# EasyEDA Pro project ProPrj_Avaota A1 八核 AIoT 开发板_2024-05-03.epro, schematic Avaota Pi A, sheets 1 to 5 of 13

## Sheets
1 POWER
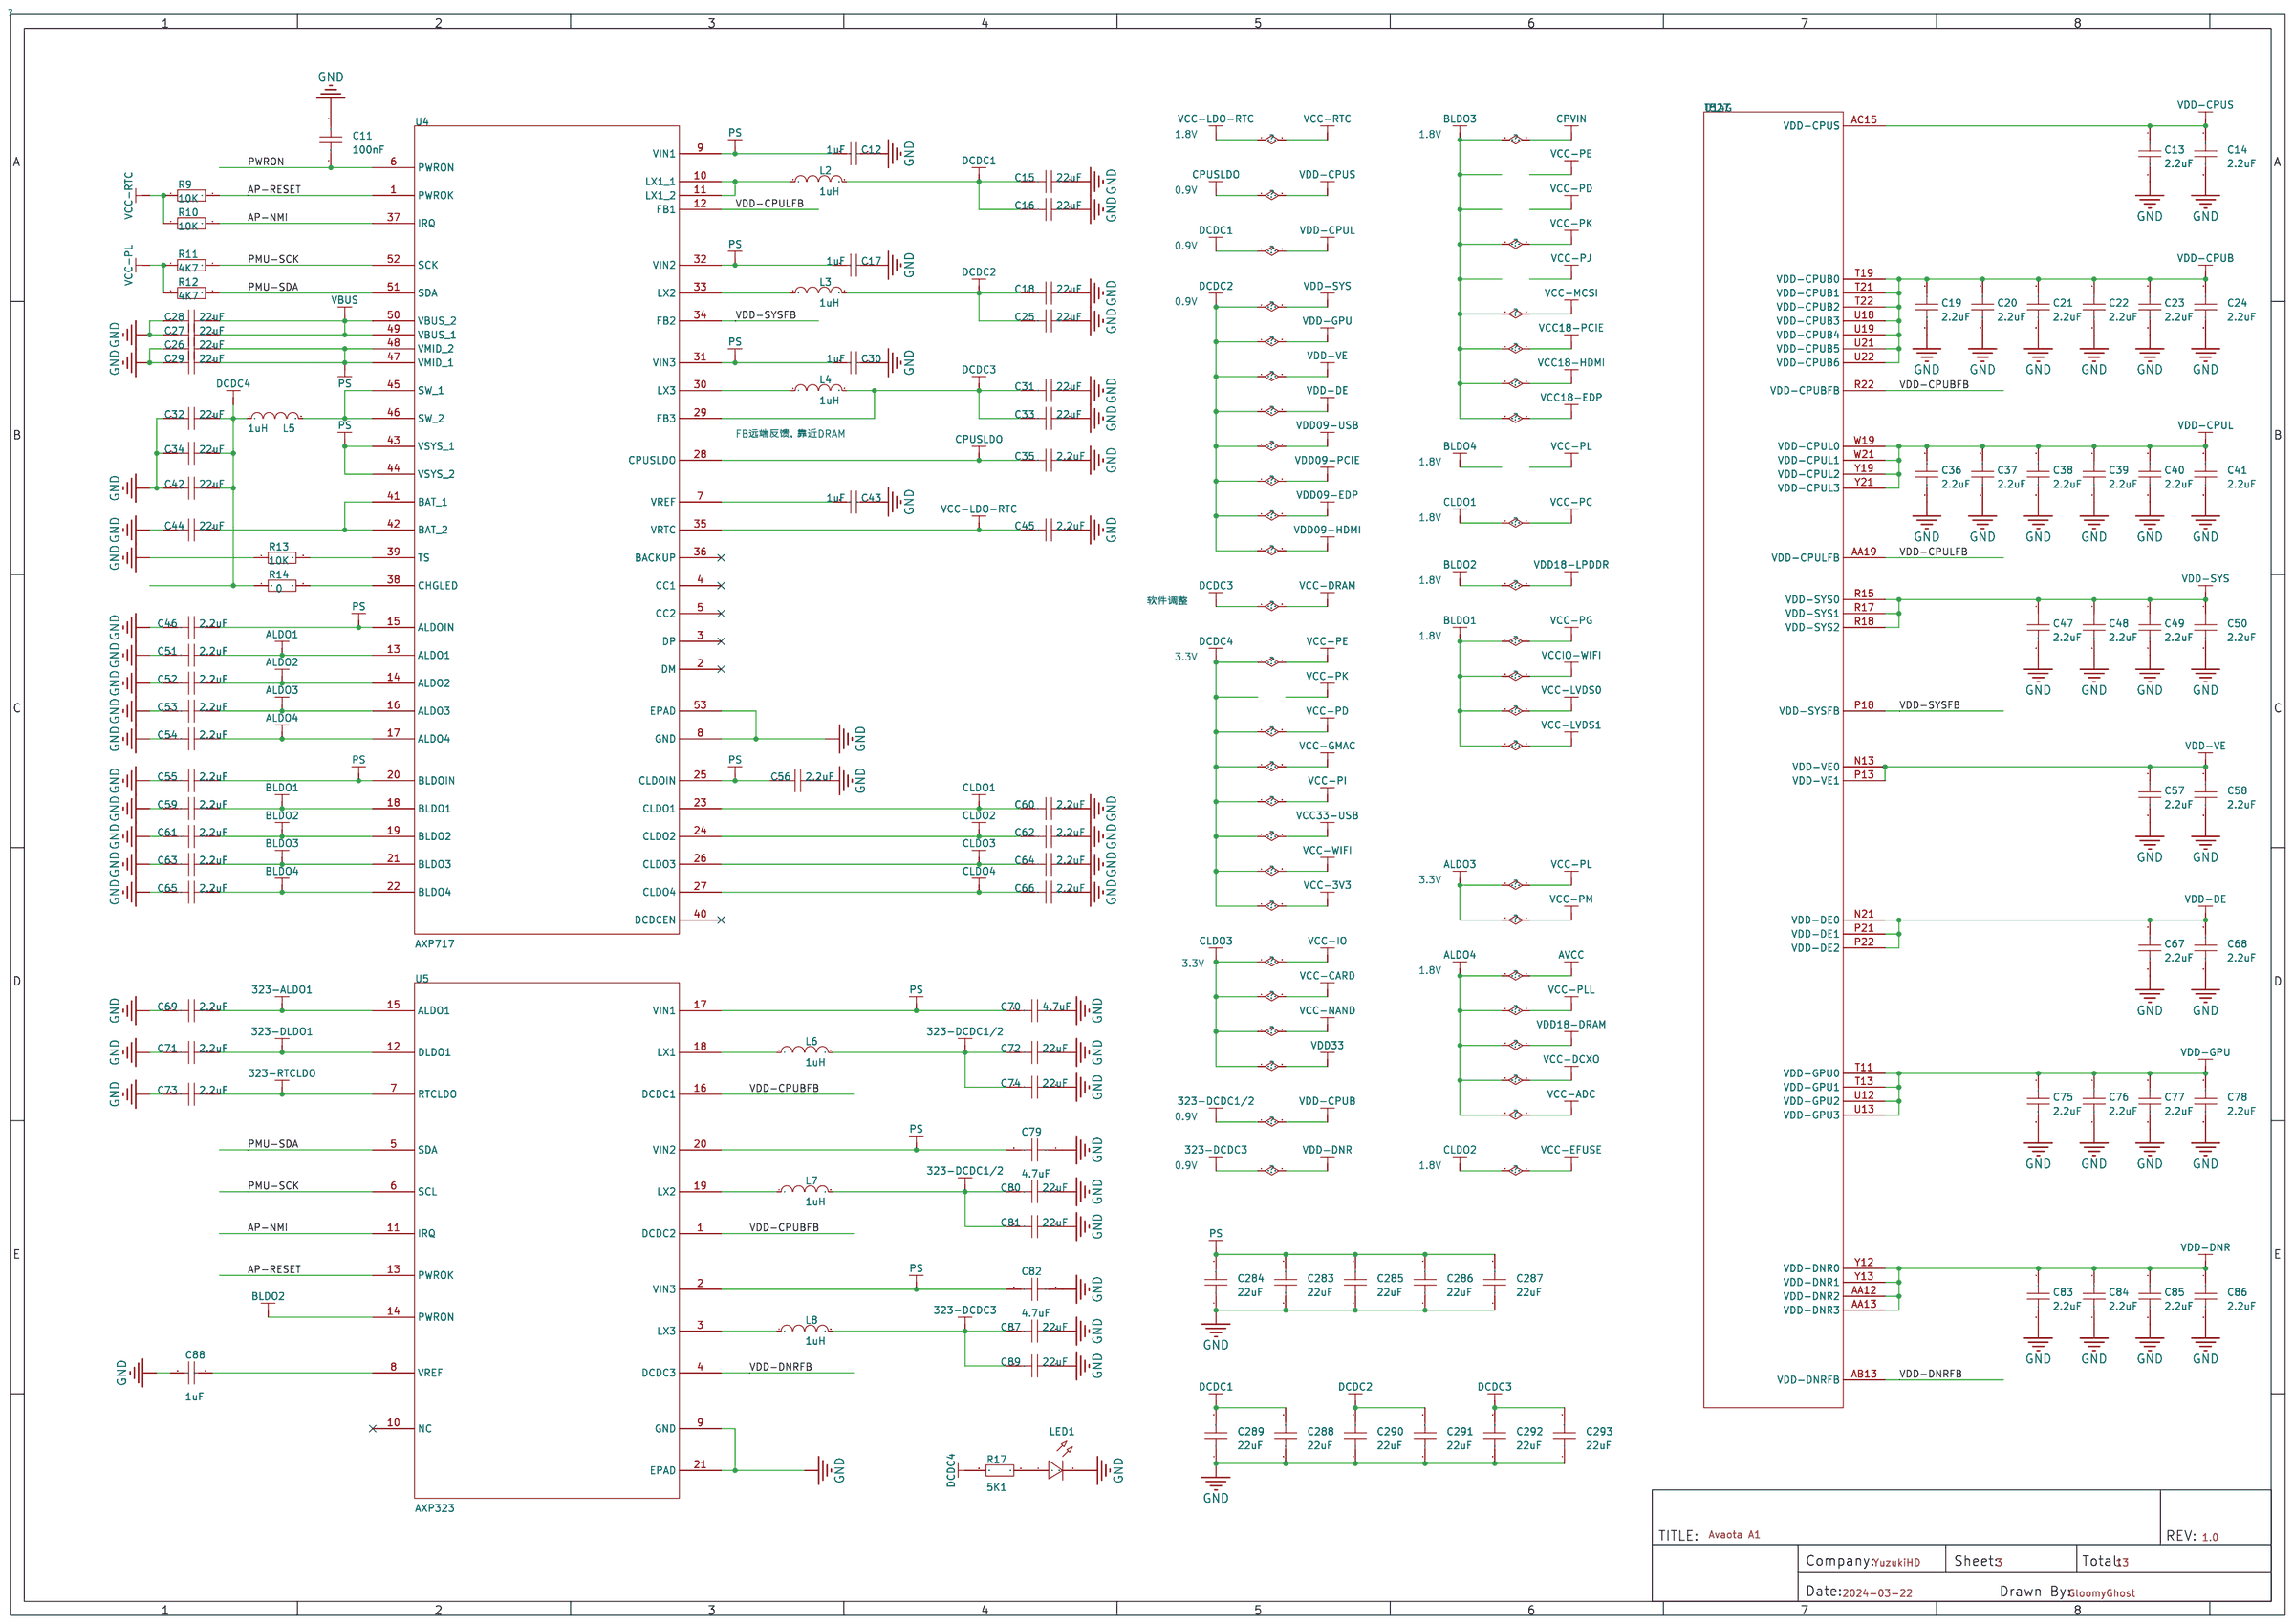
[diagram p0: POWER]
2 SYSTEM
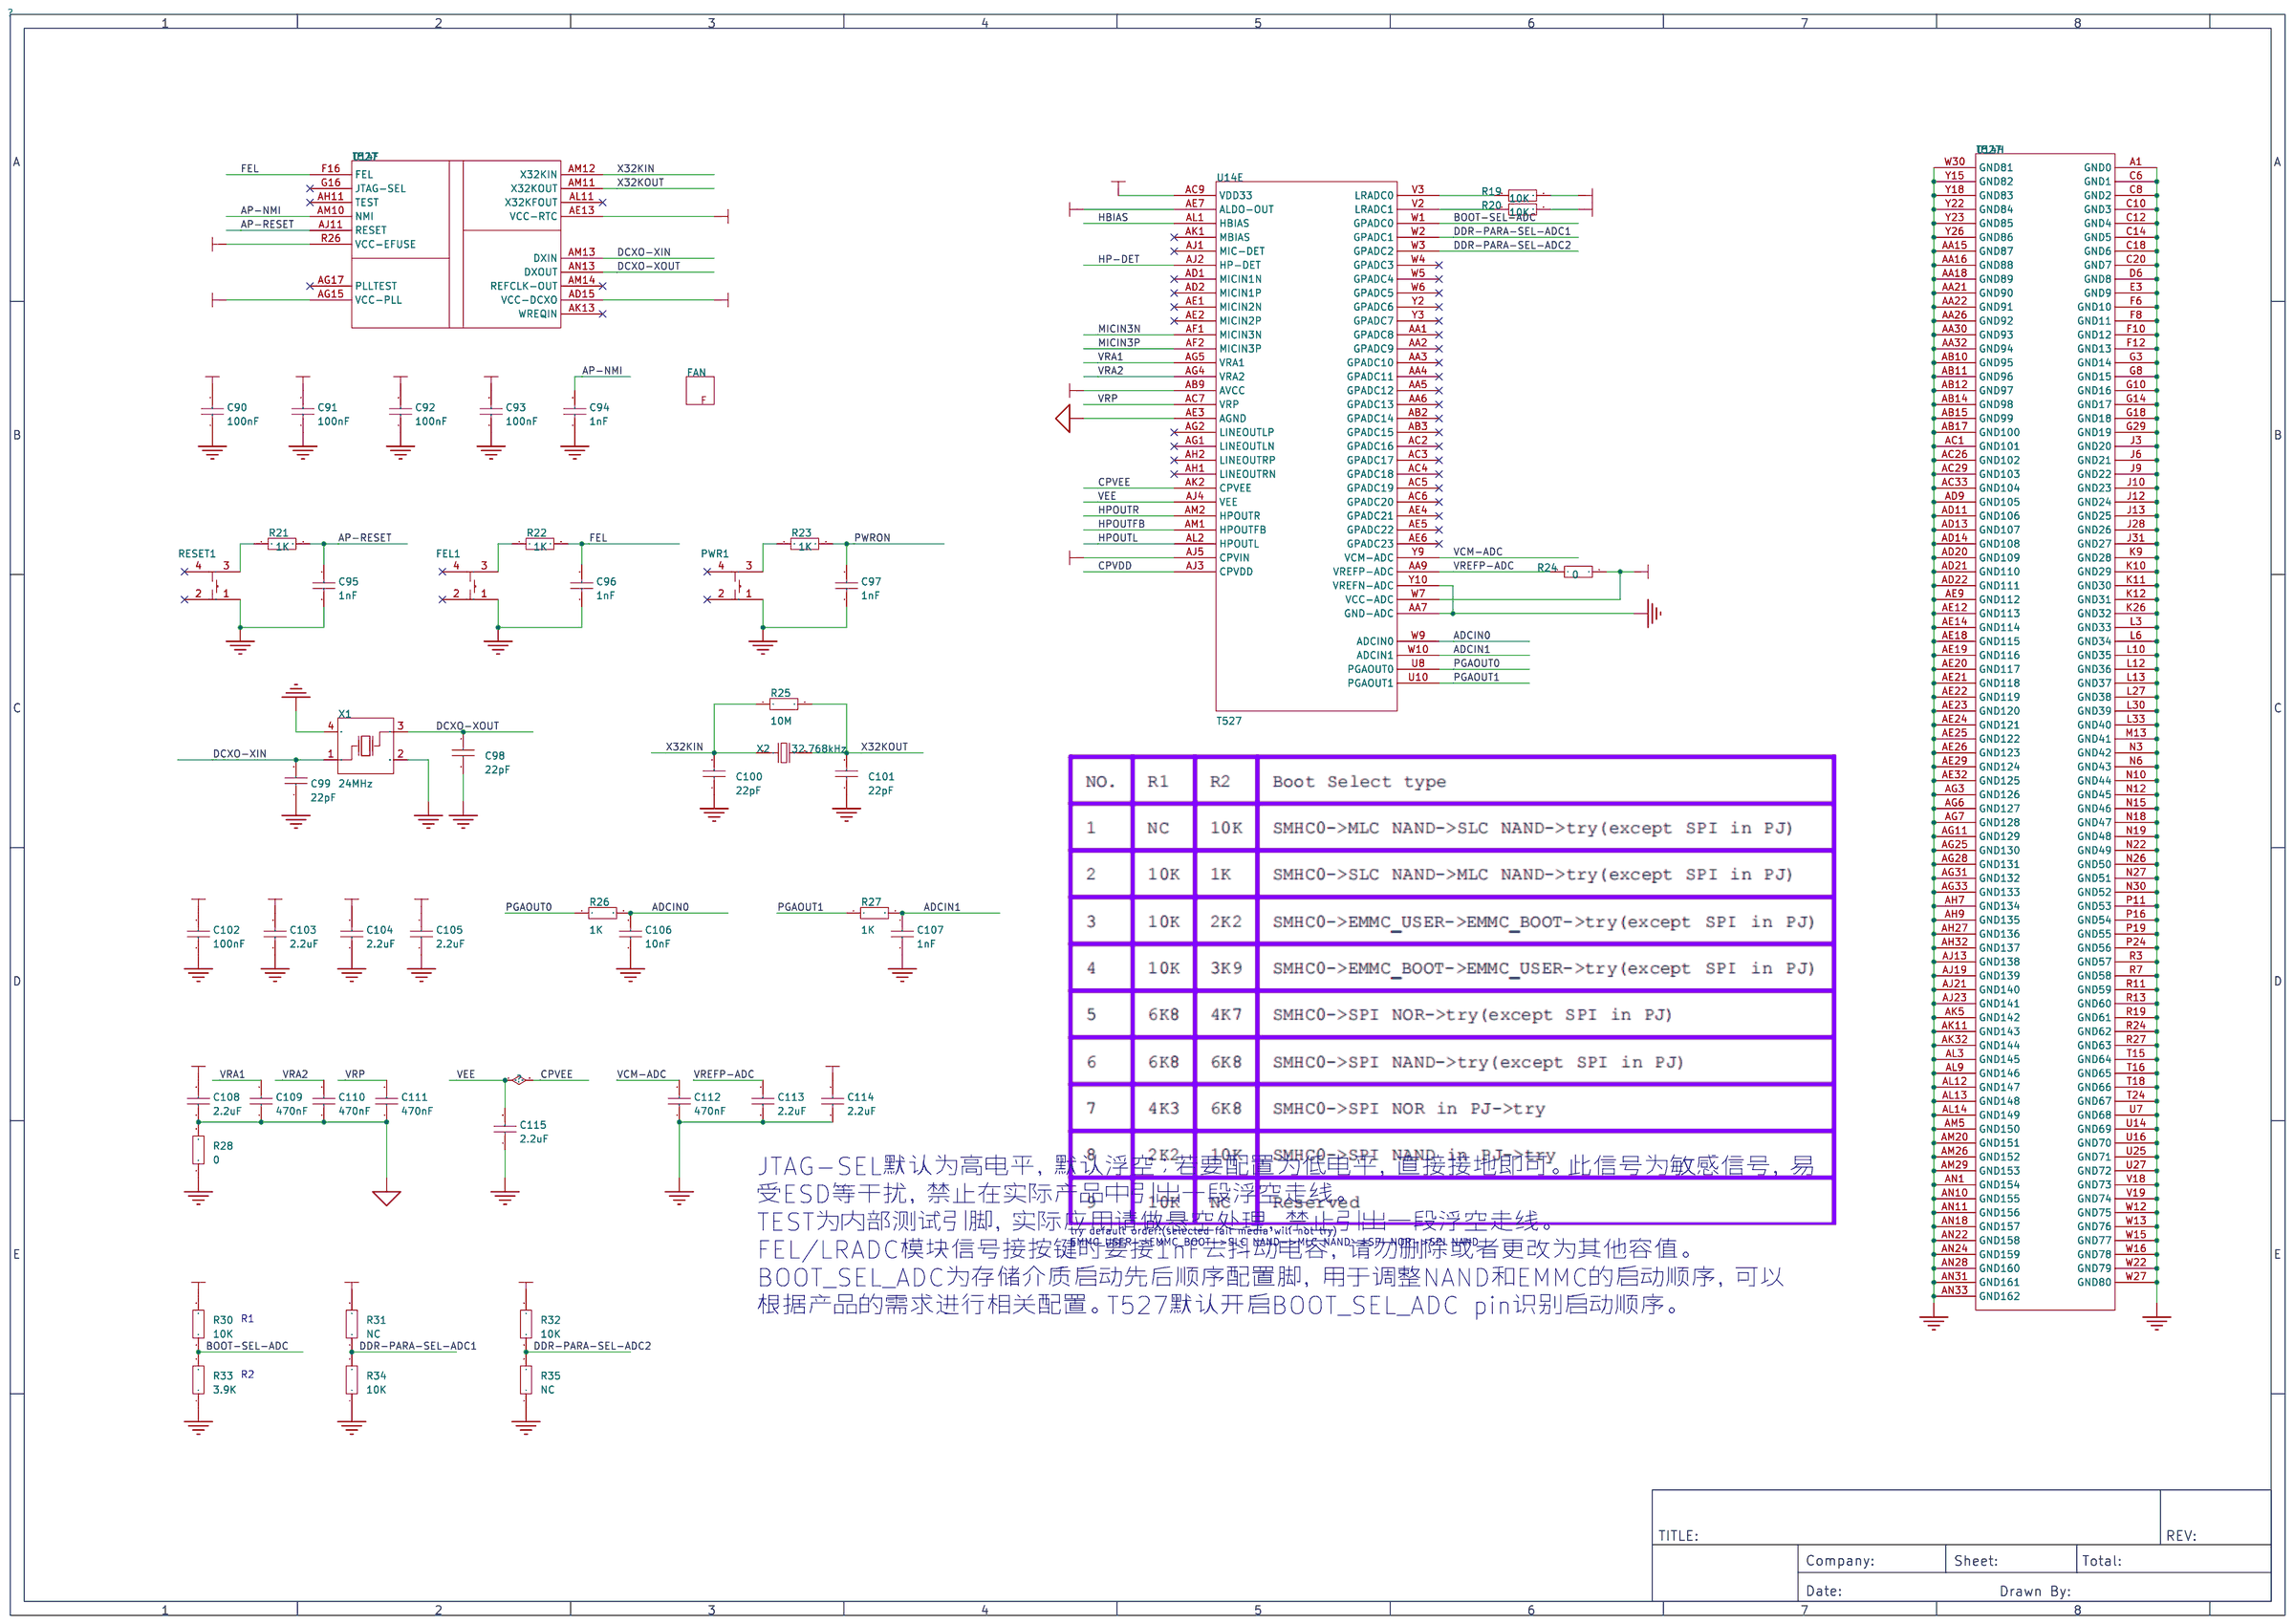
[diagram p1: SYSTEM]
3 DRAM
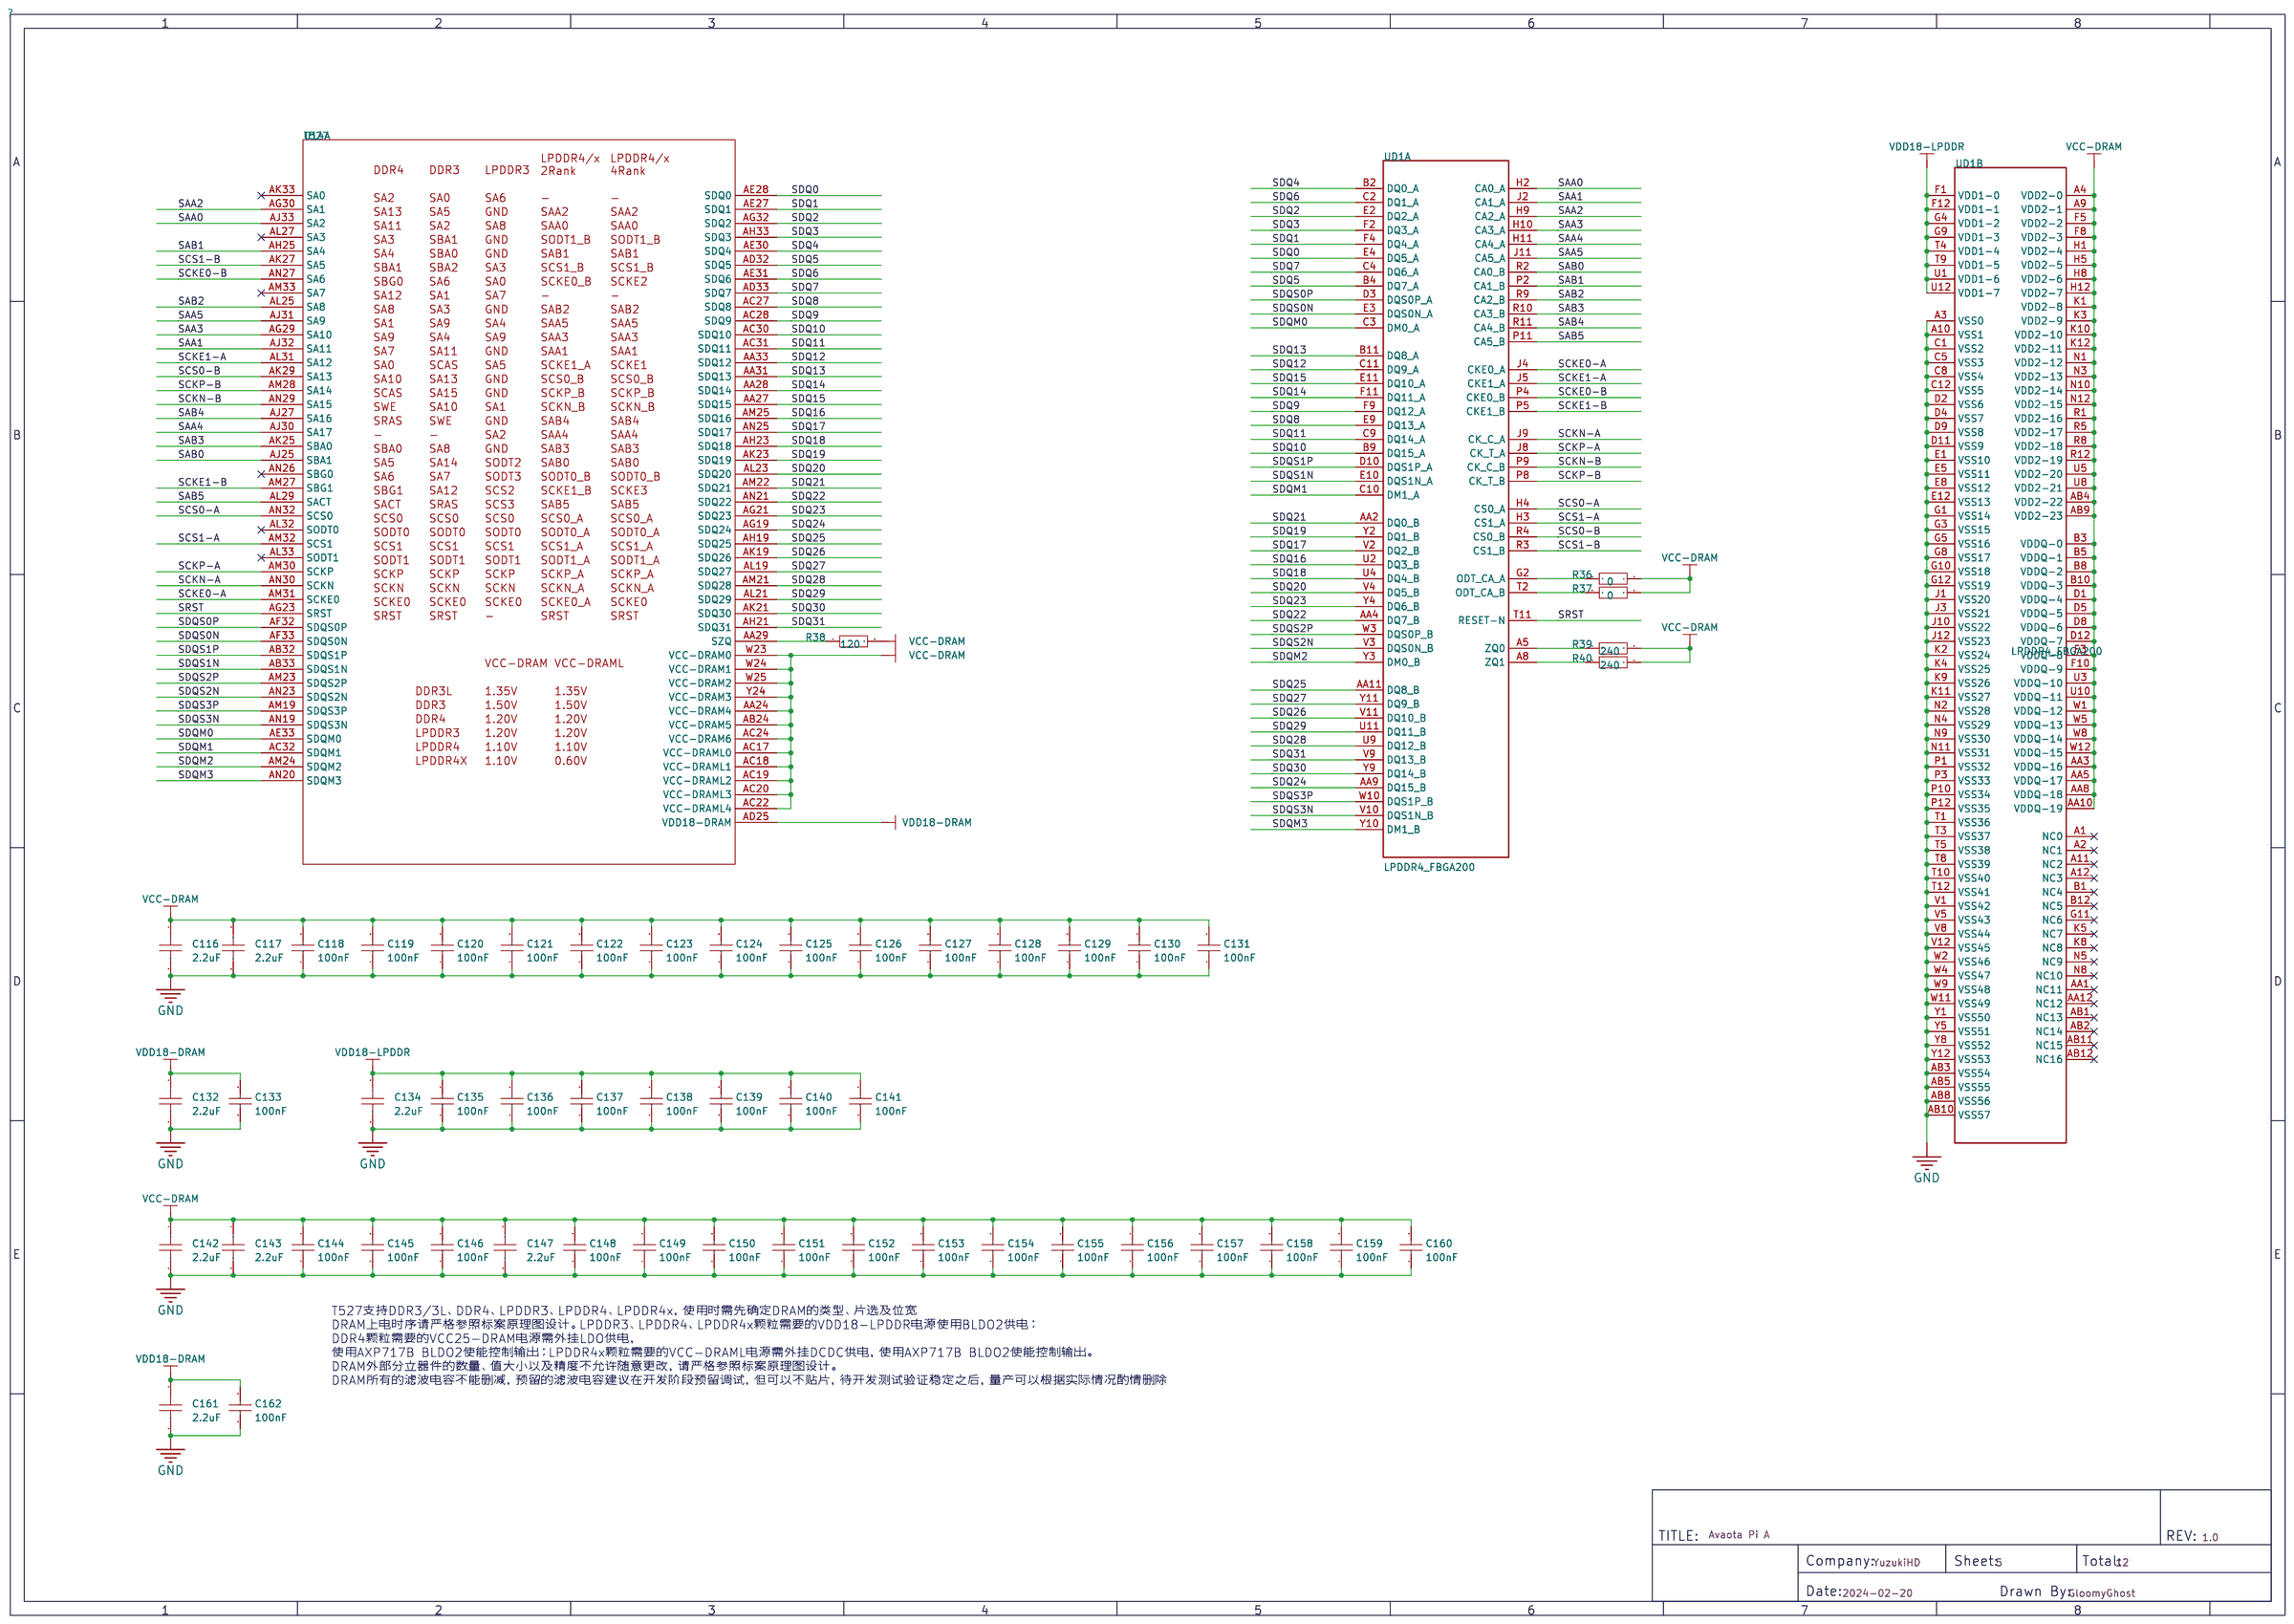
[diagram p2: DRAM]
4 GPIO1
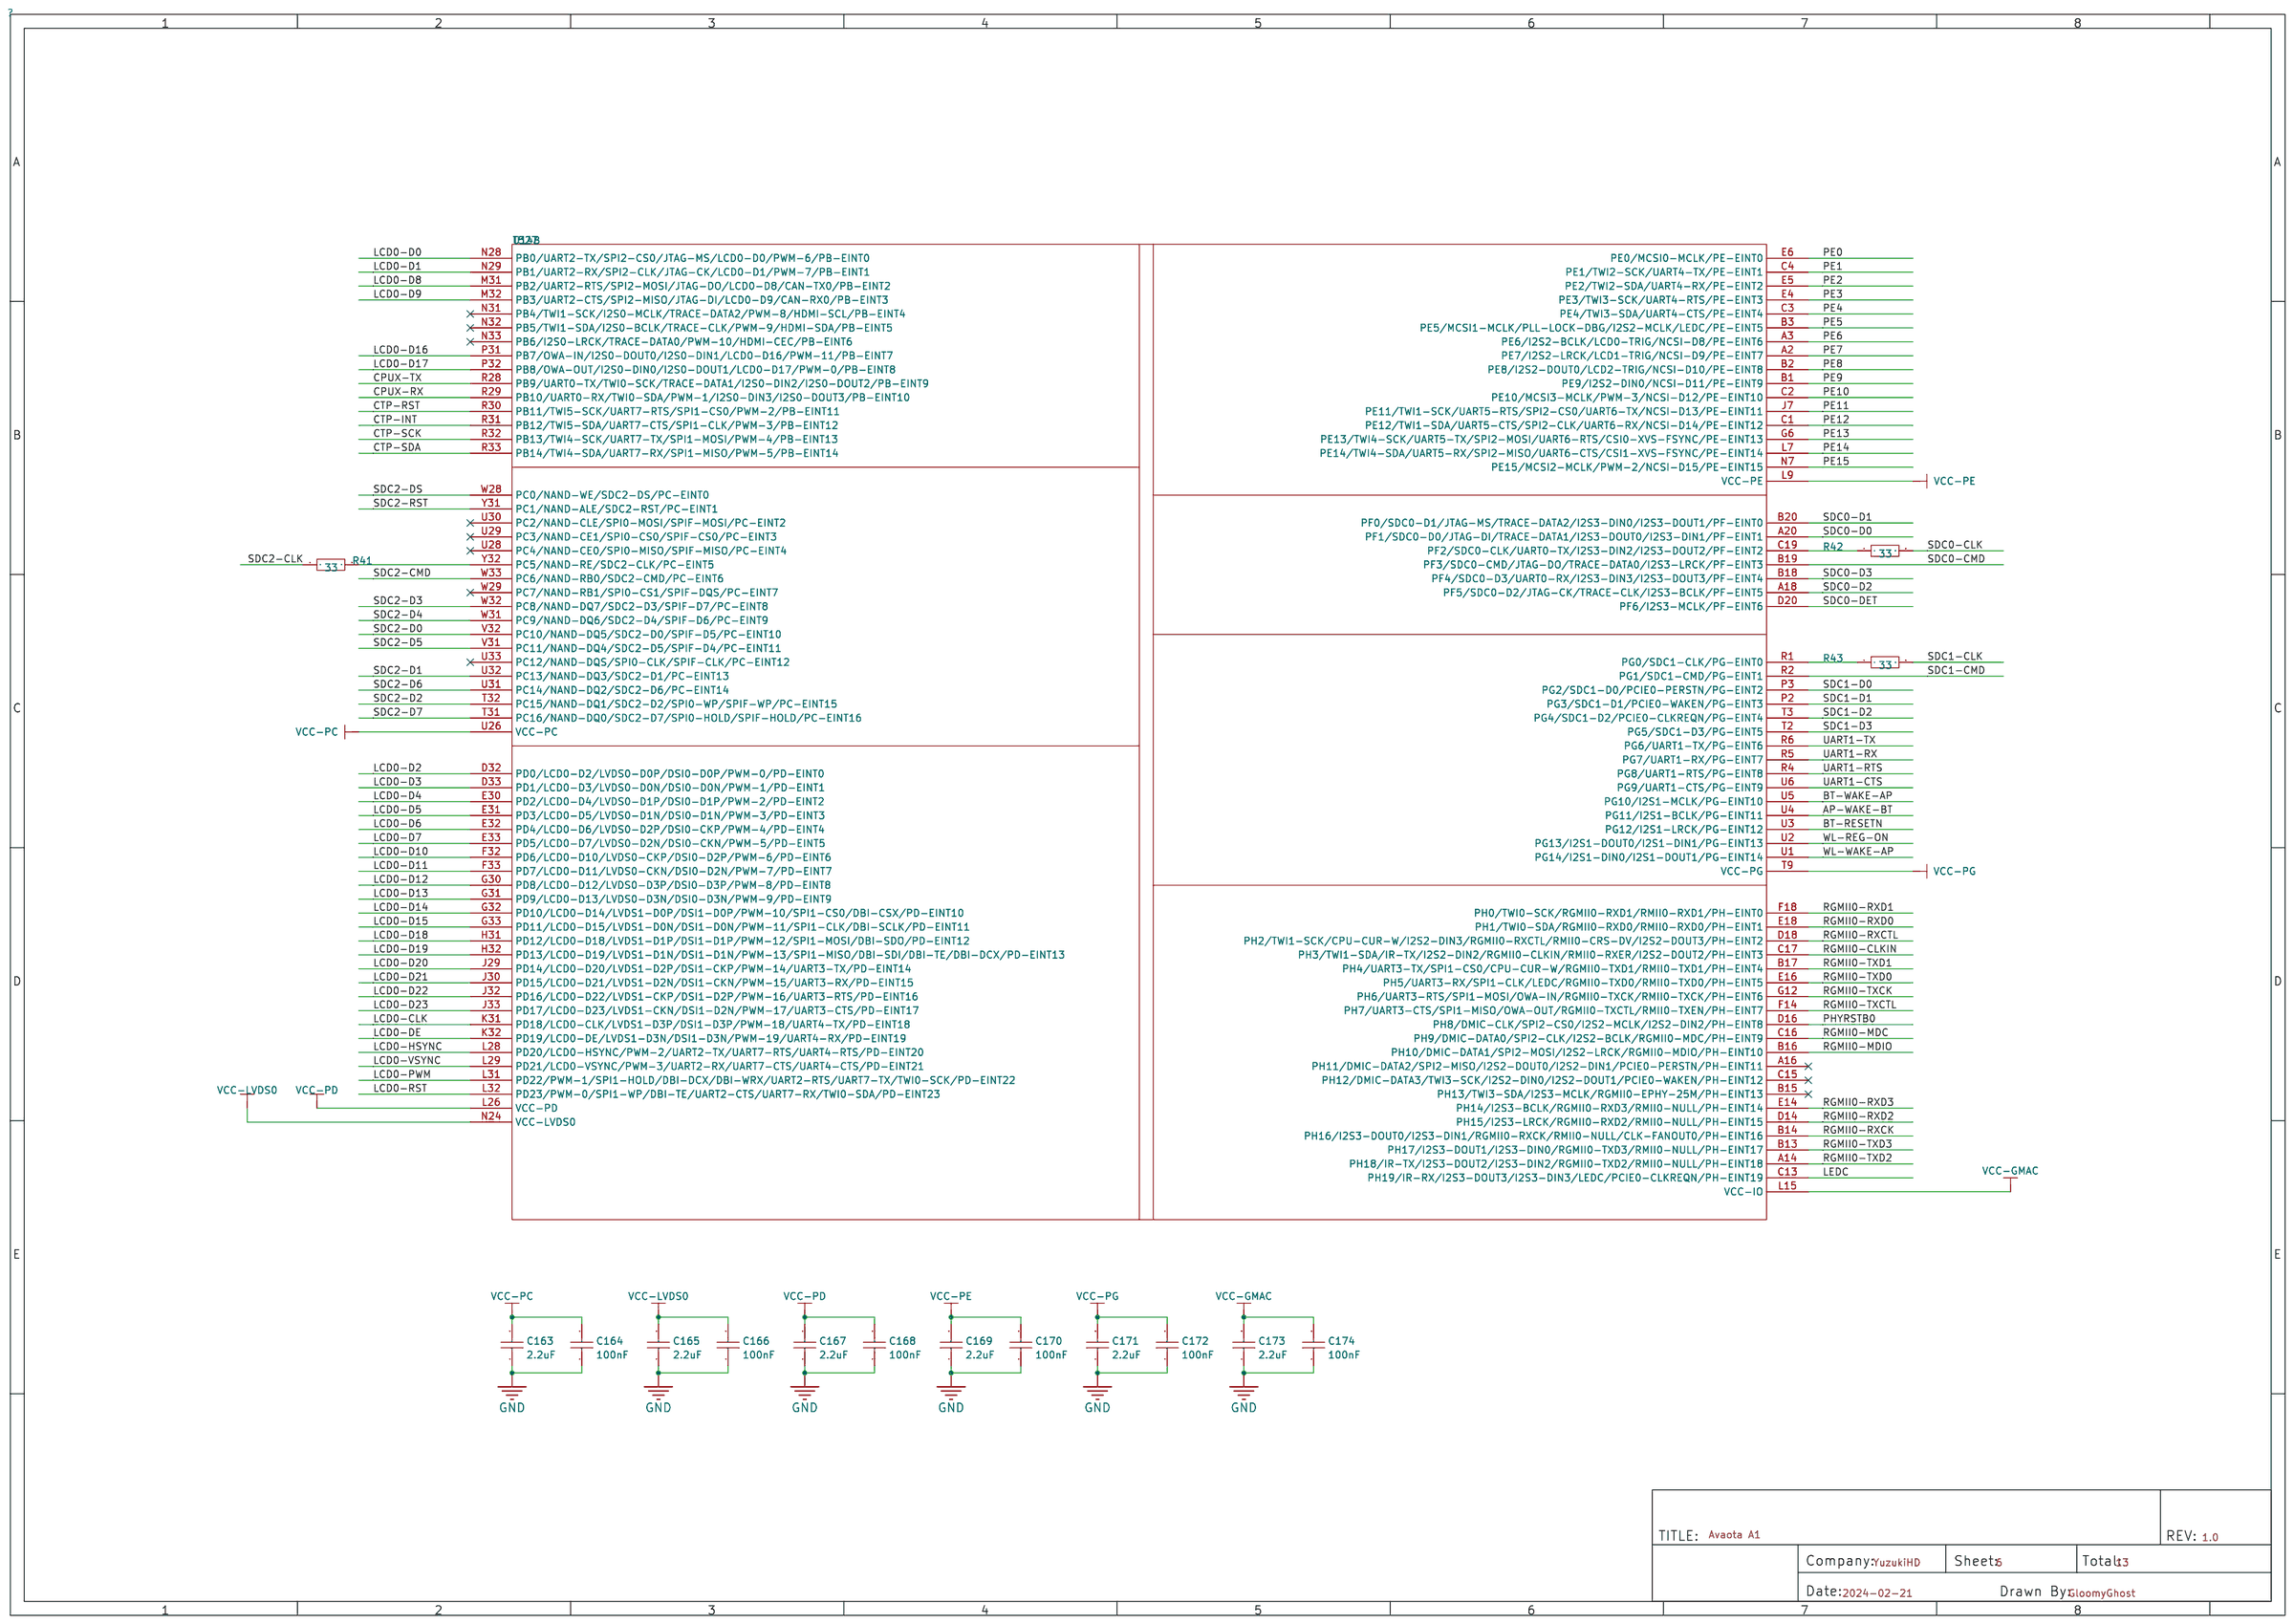
[diagram p3: GPIO1]
5 GPIO2